# EAGLE board Resistor_Resistor (EAGLE 8.3.0), part 16 of 32
## Placement (x,y rotation side) (continued)
R19241  10K  [0201]  142.39,25.65 0 top
R19242  10K  [0201]  142.39,26.26 0 top
R19243  10K  [0201]  142.39,26.87 0 top
R19244  10K  [0201]  142.39,27.48 0 top
R19245  10K  [0201]  142.39,28.09 0 top
R19246  10K  [0201]  142.39,28.7 0 top
R19247  10K  [0201]  142.39,29.31 0 top
R19248  10K  [0201]  142.39,29.92 0 top
R19249  10K  [0201]  142.39,30.53 0 top
R19250  10K  [0201]  142.39,31.14 0 top
R19251  10K  [0201]  142.39,31.75 0 top
R19252  10K  [0201]  142.39,32.36 0 top
R19253  10K  [0201]  142.39,32.97 0 top
R19254  10K  [0201]  142.39,33.58 0 top
R19255  10K  [0201]  142.39,34.19 0 top
R19256  10K  [0201]  142.39,34.8 0 top
R19257  10K  [0201]  142.39,35.41 0 top
R19258  10K  [0201]  142.39,36.02 0 top
R19259  10K  [0201]  142.39,36.63 0 top
R19260  10K  [0201]  142.39,37.24 0 top
R19261  10K  [0201]  142.39,37.85 0 top
R19262  10K  [0201]  142.39,38.46 0 top
R19263  10K  [0201]  142.39,39.07 0 top
R19264  10K  [0201]  142.39,39.67 0 top
R19265  10K  [0201]  142.39,40.28 0 top
R19266  10K  [0201]  142.39,40.89 0 top
R19267  10K  [0201]  142.39,41.5 0 top
R19268  10K  [0201]  142.39,42.11 0 top
R19269  10K  [0201]  142.39,42.72 0 top
R19270  10K  [0201]  142.39,43.33 0 top
R19271  10K  [0201]  142.39,43.94 0 top
R19272  10K  [0201]  142.39,44.55 0 top
R19273  10K  [0201]  142.39,45.16 0 top
R19274  10K  [0201]  142.39,45.77 0 top
R19275  10K  [0201]  142.39,46.38 0 top
R19276  10K  [0201]  142.39,46.99 0 top
R19277  10K  [0201]  142.39,47.6 0 top
R19278  10K  [0201]  142.39,48.21 0 top
R19279  10K  [0201]  142.39,48.82 0 top
R19280  10K  [0201]  142.39,49.43 0 top
R19281  10K  [0201]  142.39,50.04 0 top
R19282  10K  [0201]  142.39,50.65 0 top
R19283  10K  [0201]  142.39,51.26 0 top
R19284  10K  [0201]  142.39,51.87 0 top
R19285  10K  [0201]  142.39,52.48 0 top
R19286  10K  [0201]  142.39,53.09 0 top
R19287  10K  [0201]  142.39,53.7 0 top
R19288  10K  [0201]  142.39,54.31 0 top
R19289  10K  [0201]  142.39,54.91 0 top
R19290  10K  [0201]  142.39,55.52 0 top
R19291  10K  [0201]  142.39,56.13 0 top
R19292  10K  [0201]  142.39,56.74 0 top
R19293  10K  [0201]  142.39,57.35 0 top
R19294  10K  [0201]  142.39,57.96 0 top
R19295  10K  [0201]  142.39,58.57 0 top
R19296  10K  [0201]  142.39,59.18 0 top
R19297  10K  [0201]  142.39,59.79 0 top
R19298  10K  [0201]  142.39,60.4 0 top
R19299  10K  [0201]  142.39,61.01 0 top
R19300  10K  [0201]  142.39,61.62 0 top
R19301  10K  [0201]  142.39,62.23 0 top
R19302  10K  [0201]  142.39,62.84 0 top
R19303  10K  [0201]  142.39,63.45 0 top
R19304  10K  [0201]  142.39,64.06 0 top
R19305  10K  [0201]  142.39,64.67 0 top
R19306  10K  [0201]  142.39,65.28 0 top
R19307  10K  [0201]  142.39,65.89 0 top
R19308  10K  [0201]  142.39,66.5 0 top
R19309  10K  [0201]  142.39,67.11 0 top
R19310  10K  [0201]  142.39,67.72 0 top
R19311  10K  [0201]  142.39,68.33 0 top
R19312  10K  [0201]  142.39,68.94 0 top
R19313  10K  [0201]  142.39,69.55 0 top
R19314  10K  [0201]  142.39,70.15 0 top
R19315  10K  [0201]  142.39,70.76 0 top
R19316  10K  [0201]  142.39,71.37 0 top
R19317  10K  [0201]  142.39,71.98 0 top
R19318  10K  [0201]  142.39,72.59 0 top
R19319  10K  [0201]  142.39,73.2 0 top
R19320  10K  [0201]  142.39,73.81 0 top
R19321  10K  [0201]  142.39,74.42 0 top
R19322  10K  [0201]  142.39,75.03 0 top
R19323  10K  [0201]  142.39,75.64 0 top
R19324  10K  [0201]  142.39,76.25 0 top
R19325  10K  [0201]  142.39,76.86 0 top
R19326  10K  [0201]  142.39,77.47 0 top
R19327  10K  [0201]  142.39,78.08 0 top
R19328  10K  [0201]  142.39,78.69 0 top
R19329  10K  [0201]  142.39,79.3 0 top
R19330  10K  [0201]  142.39,79.91 0 top
R19331  10K  [0201]  142.39,80.52 0 top
R19332  10K  [0201]  142.39,81.13 0 top
R19333  10K  [0201]  142.39,81.74 0 top
R19334  10K  [0201]  142.39,82.35 0 top
R19335  10K  [0201]  142.39,82.96 0 top
R19336  10K  [0201]  142.39,83.57 0 top
R19337  10K  [0201]  142.39,84.18 0 top
R19338  10K  [0201]  142.39,84.79 0 top
R19339  10K  [0201]  142.39,85.39 0 top
R19340  10K  [0201]  142.39,86 0 top
R19341  10K  [0201]  142.39,86.61 0 top
R19342  10K  [0201]  142.39,87.22 0 top
R19343  10K  [0201]  142.39,87.83 0 top
R19344  10K  [0201]  142.39,88.44 0 top
R19345  10K  [0201]  142.39,89.05 0 top
R19346  10K  [0201]  142.39,89.66 0 top
R19347  10K  [0201]  142.39,90.27 0 top
R19348  10K  [0201]  142.39,90.88 0 top
R19349  10K  [0201]  142.39,91.49 0 top
R19350  10K  [0201]  142.39,92.1 0 top
R19351  10K  [0201]  142.39,92.71 0 top
R19352  10K  [0201]  142.39,93.32 0 top
R19353  10K  [0201]  142.39,93.93 0 top
R19354  10K  [0201]  142.39,94.54 0 top
R19355  10K  [0201]  142.39,95.15 0 top
R19356  10K  [0201]  142.39,95.76 0 top
R19357  10K  [0201]  142.39,96.37 0 top
R19358  10K  [0201]  142.39,96.98 0 top
R19359  10K  [0201]  142.39,97.59 0 top
R19360  10K  [0201]  142.39,98.2 0 top
R19361  10K  [0201]  142.39,98.81 0 top
R19362  10K  [0201]  142.39,99.42 0 top
R19363  10K  [0201]  142.39,100.03 0 top
R19364  10K  [0201]  142.39,100.63 0 top
R19365  10K  [0201]  142.39,101.24 0 top
R19366  10K  [0201]  142.39,101.85 0 top
R19367  10K  [0201]  142.39,102.46 0 top
R19368  10K  [0201]  142.39,103.07 0 top
R19369  10K  [0201]  142.39,103.68 0 top
R19370  10K  [0201]  142.39,104.29 0 top
R19371  10K  [0201]  142.39,104.9 0 top
R19372  10K  [0201]  142.39,105.51 0 top
R19373  10K  [0201]  142.39,106.12 0 top
R19374  10K  [0201]  142.39,106.73 0 top
R19375  10K  [0201]  142.39,107.34 0 top
R19376  10K  [0201]  142.39,107.95 0 top
R19377  10K  [0201]  142.39,108.56 0 top
R19378  10K  [0201]  142.39,109.17 0 top
R19379  10K  [0201]  142.39,109.78 0 top
R19380  10K  [0201]  142.39,110.39 0 top
R19381  10K  [0201]  142.39,111 0 top
R19382  10K  [0201]  142.39,111.61 0 top
R19383  10K  [0201]  142.39,112.22 0 top
R19384  10K  [0201]  142.39,112.83 0 top
R19385  10K  [0201]  142.39,113.44 0 top
R19386  10K  [0201]  142.39,114.05 0 top
R19387  10K  [0201]  142.39,114.66 0 top
R19388  10K  [0201]  142.39,115.27 0 top
R19389  10K  [0201]  142.39,115.87 0 top
R19390  10K  [0201]  142.39,116.48 0 top
R19391  10K  [0201]  142.39,117.09 0 top
R19392  10K  [0201]  142.39,117.7 0 top
R19393  10K  [0201]  142.39,118.31 0 top
R19394  10K  [0201]  142.39,118.92 0 top
R19395  10K  [0201]  142.39,119.53 0 top
R19396  10K  [0201]  142.39,120.14 0 top
R19397  10K  [0201]  142.39,120.75 0 top
R19398  10K  [0201]  142.39,121.36 0 top
R19399  10K  [0201]  142.39,121.97 0 top
R19400  10K  [0201]  142.39,122.58 0 top
R19401  10K  [0201]  143.61,1.27 0 top
R19402  10K  [0201]  143.61,1.88 0 top
R19403  10K  [0201]  143.61,2.49 0 top
R19404  10K  [0201]  143.61,3.1 0 top
R19405  10K  [0201]  143.61,3.71 0 top
R19406  10K  [0201]  143.61,4.32 0 top
R19407  10K  [0201]  143.61,4.93 0 top
R19408  10K  [0201]  143.61,5.54 0 top
R19409  10K  [0201]  143.61,6.15 0 top
R19410  10K  [0201]  143.61,6.76 0 top
R19411  10K  [0201]  143.61,7.37 0 top
R19412  10K  [0201]  143.61,7.98 0 top
R19413  10K  [0201]  143.61,8.59 0 top
R19414  10K  [0201]  143.61,9.19 0 top
R19415  10K  [0201]  143.61,9.8 0 top
R19416  10K  [0201]  143.61,10.41 0 top
R19417  10K  [0201]  143.61,11.02 0 top
R19418  10K  [0201]  143.61,11.63 0 top
R19419  10K  [0201]  143.61,12.24 0 top
R19420  10K  [0201]  143.61,12.85 0 top
R19421  10K  [0201]  143.61,13.46 0 top
R19422  10K  [0201]  143.61,14.07 0 top
R19423  10K  [0201]  143.61,14.68 0 top
R19424  10K  [0201]  143.61,15.29 0 top
R19425  10K  [0201]  143.61,15.9 0 top
R19426  10K  [0201]  143.61,16.51 0 top
R19427  10K  [0201]  143.61,17.12 0 top
R19428  10K  [0201]  143.61,17.73 0 top
R19429  10K  [0201]  143.61,18.34 0 top
R19430  10K  [0201]  143.61,18.95 0 top
R19431  10K  [0201]  143.61,19.56 0 top
R19432  10K  [0201]  143.61,20.17 0 top
R19433  10K  [0201]  143.61,20.78 0 top
R19434  10K  [0201]  143.61,21.39 0 top
R19435  10K  [0201]  143.61,22 0 top
R19436  10K  [0201]  143.61,22.61 0 top
R19437  10K  [0201]  143.61,23.22 0 top
R19438  10K  [0201]  143.61,23.83 0 top
R19439  10K  [0201]  143.61,24.43 0 top
R19440  10K  [0201]  143.61,25.04 0 top
R19441  10K  [0201]  143.61,25.65 0 top
R19442  10K  [0201]  143.61,26.26 0 top
R19443  10K  [0201]  143.61,26.87 0 top
R19444  10K  [0201]  143.61,27.48 0 top
R19445  10K  [0201]  143.61,28.09 0 top
R19446  10K  [0201]  143.61,28.7 0 top
R19447  10K  [0201]  143.61,29.31 0 top
R19448  10K  [0201]  143.61,29.92 0 top
R19449  10K  [0201]  143.61,30.53 0 top
R19450  10K  [0201]  143.61,31.14 0 top
R19451  10K  [0201]  143.61,31.75 0 top
R19452  10K  [0201]  143.61,32.36 0 top
R19453  10K  [0201]  143.61,32.97 0 top
R19454  10K  [0201]  143.61,33.58 0 top
R19455  10K  [0201]  143.61,34.19 0 top
R19456  10K  [0201]  143.61,34.8 0 top
R19457  10K  [0201]  143.61,35.41 0 top
R19458  10K  [0201]  143.61,36.02 0 top
R19459  10K  [0201]  143.61,36.63 0 top
R19460  10K  [0201]  143.61,37.24 0 top
R19461  10K  [0201]  143.61,37.85 0 top
R19462  10K  [0201]  143.61,38.46 0 top
R19463  10K  [0201]  143.61,39.07 0 top
R19464  10K  [0201]  143.61,39.67 0 top
R19465  10K  [0201]  143.61,40.28 0 top
R19466  10K  [0201]  143.61,40.89 0 top
R19467  10K  [0201]  143.61,41.5 0 top
R19468  10K  [0201]  143.61,42.11 0 top
R19469  10K  [0201]  143.61,42.72 0 top
R19470  10K  [0201]  143.61,43.33 0 top
R19471  10K  [0201]  143.61,43.94 0 top
R19472  10K  [0201]  143.61,44.55 0 top
R19473  10K  [0201]  143.61,45.16 0 top
R19474  10K  [0201]  143.61,45.77 0 top
R19475  10K  [0201]  143.61,46.38 0 top
R19476  10K  [0201]  143.61,46.99 0 top
R19477  10K  [0201]  143.61,47.6 0 top
R19478  10K  [0201]  143.61,48.21 0 top
R19479  10K  [0201]  143.61,48.82 0 top
R19480  10K  [0201]  143.61,49.43 0 top
R19481  10K  [0201]  143.61,50.04 0 top
R19482  10K  [0201]  143.61,50.65 0 top
R19483  10K  [0201]  143.61,51.26 0 top
R19484  10K  [0201]  143.61,51.87 0 top
R19485  10K  [0201]  143.61,52.48 0 top
R19486  10K  [0201]  143.61,53.09 0 top
R19487  10K  [0201]  143.61,53.7 0 top
R19488  10K  [0201]  143.61,54.31 0 top
R19489  10K  [0201]  143.61,54.91 0 top
R19490  10K  [0201]  143.61,55.52 0 top
R19491  10K  [0201]  143.61,56.13 0 top
R19492  10K  [0201]  143.61,56.74 0 top
R19493  10K  [0201]  143.61,57.35 0 top
R19494  10K  [0201]  143.61,57.96 0 top
R19495  10K  [0201]  143.61,58.57 0 top
R19496  10K  [0201]  143.61,59.18 0 top
R19497  10K  [0201]  143.61,59.79 0 top
R19498  10K  [0201]  143.61,60.4 0 top
R19499  10K  [0201]  143.61,61.01 0 top
R19500  10K  [0201]  143.61,61.62 0 top
R19501  10K  [0201]  143.61,62.23 0 top
R19502  10K  [0201]  143.61,62.84 0 top
R19503  10K  [0201]  143.61,63.45 0 top
R19504  10K  [0201]  143.61,64.06 0 top
R19505  10K  [0201]  143.61,64.67 0 top
R19506  10K  [0201]  143.61,65.28 0 top
R19507  10K  [0201]  143.61,65.89 0 top
R19508  10K  [0201]  143.61,66.5 0 top
R19509  10K  [0201]  143.61,67.11 0 top
R19510  10K  [0201]  143.61,67.72 0 top
R19511  10K  [0201]  143.61,68.33 0 top
R19512  10K  [0201]  143.61,68.94 0 top
R19513  10K  [0201]  143.61,69.55 0 top
R19514  10K  [0201]  143.61,70.15 0 top
R19515  10K  [0201]  143.61,70.76 0 top
R19516  10K  [0201]  143.61,71.37 0 top
R19517  10K  [0201]  143.61,71.98 0 top
R19518  10K  [0201]  143.61,72.59 0 top
R19519  10K  [0201]  143.61,73.2 0 top
R19520  10K  [0201]  143.61,73.81 0 top
R19521  10K  [0201]  143.61,74.42 0 top
R19522  10K  [0201]  143.61,75.03 0 top
R19523  10K  [0201]  143.61,75.64 0 top
R19524  10K  [0201]  143.61,76.25 0 top
R19525  10K  [0201]  143.61,76.86 0 top
R19526  10K  [0201]  143.61,77.47 0 top
R19527  10K  [0201]  143.61,78.08 0 top
R19528  10K  [0201]  143.61,78.69 0 top
R19529  10K  [0201]  143.61,79.3 0 top
R19530  10K  [0201]  143.61,79.91 0 top
R19531  10K  [0201]  143.61,80.52 0 top
R19532  10K  [0201]  143.61,81.13 0 top
R19533  10K  [0201]  143.61,81.74 0 top
R19534  10K  [0201]  143.61,82.35 0 top
R19535  10K  [0201]  143.61,82.96 0 top
R19536  10K  [0201]  143.61,83.57 0 top
R19537  10K  [0201]  143.61,84.18 0 top
R19538  10K  [0201]  143.61,84.79 0 top
R19539  10K  [0201]  143.61,85.39 0 top
R19540  10K  [0201]  143.61,86 0 top
R19541  10K  [0201]  143.61,86.61 0 top
R19542  10K  [0201]  143.61,87.22 0 top
R19543  10K  [0201]  143.61,87.83 0 top
R19544  10K  [0201]  143.61,88.44 0 top
R19545  10K  [0201]  143.61,89.05 0 top
R19546  10K  [0201]  143.61,89.66 0 top
R19547  10K  [0201]  143.61,90.27 0 top
R19548  10K  [0201]  143.61,90.88 0 top
R19549  10K  [0201]  143.61,91.49 0 top
R19550  10K  [0201]  143.61,92.1 0 top
R19551  10K  [0201]  143.61,92.71 0 top
R19552  10K  [0201]  143.61,93.32 0 top
R19553  10K  [0201]  143.61,93.93 0 top
R19554  10K  [0201]  143.61,94.54 0 top
R19555  10K  [0201]  143.61,95.15 0 top
R19556  10K  [0201]  143.61,95.76 0 top
R19557  10K  [0201]  143.61,96.37 0 top
R19558  10K  [0201]  143.61,96.98 0 top
R19559  10K  [0201]  143.61,97.59 0 top
R19560  10K  [0201]  143.61,98.2 0 top
R19561  10K  [0201]  143.61,98.81 0 top
R19562  10K  [0201]  143.61,99.42 0 top
R19563  10K  [0201]  143.61,100.03 0 top
R19564  10K  [0201]  143.61,100.63 0 top
R19565  10K  [0201]  143.61,101.24 0 top
R19566  10K  [0201]  143.61,101.85 0 top
R19567  10K  [0201]  143.61,102.46 0 top
R19568  10K  [0201]  143.61,103.07 0 top
R19569  10K  [0201]  143.61,103.68 0 top
R19570  10K  [0201]  143.61,104.29 0 top
R19571  10K  [0201]  143.61,104.9 0 top
R19572  10K  [0201]  143.61,105.51 0 top
R19573  10K  [0201]  143.61,106.12 0 top
R19574  10K  [0201]  143.61,106.73 0 top
R19575  10K  [0201]  143.61,107.34 0 top
R19576  10K  [0201]  143.61,107.95 0 top
R19577  10K  [0201]  143.61,108.56 0 top
R19578  10K  [0201]  143.61,109.17 0 top
R19579  10K  [0201]  143.61,109.78 0 top
R19580  10K  [0201]  143.61,110.39 0 top
R19581  10K  [0201]  143.61,111 0 top
R19582  10K  [0201]  143.61,111.61 0 top
R19583  10K  [0201]  143.61,112.22 0 top
R19584  10K  [0201]  143.61,112.83 0 top
R19585  10K  [0201]  143.61,113.44 0 top
R19586  10K  [0201]  143.61,114.05 0 top
R19587  10K  [0201]  143.61,114.66 0 top
R19588  10K  [0201]  143.61,115.27 0 top
R19589  10K  [0201]  143.61,115.87 0 top
R19590  10K  [0201]  143.61,116.48 0 top
R19591  10K  [0201]  143.61,117.09 0 top
R19592  10K  [0201]  143.61,117.7 0 top
R19593  10K  [0201]  143.61,118.31 0 top
R19594  10K  [0201]  143.61,118.92 0 top
R19595  10K  [0201]  143.61,119.53 0 top
R19596  10K  [0201]  143.61,120.14 0 top
R19597  10K  [0201]  143.61,120.75 0 top
R19598  10K  [0201]  143.61,121.36 0 top
R19599  10K  [0201]  143.61,121.97 0 top
R19600  10K  [0201]  143.61,122.58 0 top
R19601  10K  [0201]  144.83,1.27 0 top
R19602  10K  [0201]  144.83,1.88 0 top
R19603  10K  [0201]  144.83,2.49 0 top
R19604  10K  [0201]  144.83,3.1 0 top
R19605  10K  [0201]  144.83,3.71 0 top
R19606  10K  [0201]  144.83,4.32 0 top
R19607  10K  [0201]  144.83,4.93 0 top
R19608  10K  [0201]  144.83,5.54 0 top
R19609  10K  [0201]  144.83,6.15 0 top
R19610  10K  [0201]  144.83,6.76 0 top
R19611  10K  [0201]  144.83,7.37 0 top
R19612  10K  [0201]  144.83,7.98 0 top
R19613  10K  [0201]  144.83,8.59 0 top
R19614  10K  [0201]  144.83,9.19 0 top
R19615  10K  [0201]  144.83,9.8 0 top
R19616  10K  [0201]  144.83,10.41 0 top
R19617  10K  [0201]  144.83,11.02 0 top
R19618  10K  [0201]  144.83,11.63 0 top
R19619  10K  [0201]  144.83,12.24 0 top
R19620  10K  [0201]  144.83,12.85 0 top
R19621  10K  [0201]  144.83,13.46 0 top
R19622  10K  [0201]  144.83,14.07 0 top
R19623  10K  [0201]  144.83,14.68 0 top
R19624  10K  [0201]  144.83,15.29 0 top
R19625  10K  [0201]  144.83,15.9 0 top
R19626  10K  [0201]  144.83,16.51 0 top
R19627  10K  [0201]  144.83,17.12 0 top
R19628  10K  [0201]  144.83,17.73 0 top
R19629  10K  [0201]  144.83,18.34 0 top
R19630  10K  [0201]  144.83,18.95 0 top
R19631  10K  [0201]  144.83,19.56 0 top
R19632  10K  [0201]  144.83,20.17 0 top
R19633  10K  [0201]  144.83,20.78 0 top
R19634  10K  [0201]  144.83,21.39 0 top
R19635  10K  [0201]  144.83,22 0 top
R19636  10K  [0201]  144.83,22.61 0 top
R19637  10K  [0201]  144.83,23.22 0 top
R19638  10K  [0201]  144.83,23.83 0 top
R19639  10K  [0201]  144.83,24.43 0 top
R19640  10K  [0201]  144.83,25.04 0 top
R19641  10K  [0201]  144.83,25.65 0 top
R19642  10K  [0201]  144.83,26.26 0 top
R19643  10K  [0201]  144.83,26.87 0 top
R19644  10K  [0201]  144.83,27.48 0 top
R19645  10K  [0201]  144.83,28.09 0 top
R19646  10K  [0201]  144.83,28.7 0 top
R19647  10K  [0201]  144.83,29.31 0 top
R19648  10K  [0201]  144.83,29.92 0 top
R19649  10K  [0201]  144.83,30.53 0 top
R19650  10K  [0201]  144.83,31.14 0 top
R19651  10K  [0201]  144.83,31.75 0 top
R19652  10K  [0201]  144.83,32.36 0 top
R19653  10K  [0201]  144.83,32.97 0 top
R19654  10K  [0201]  144.83,33.58 0 top
R19655  10K  [0201]  144.83,34.19 0 top
R19656  10K  [0201]  144.83,34.8 0 top
R19657  10K  [0201]  144.83,35.41 0 top
R19658  10K  [0201]  144.83,36.02 0 top
R19659  10K  [0201]  144.83,36.63 0 top
R19660  10K  [0201]  144.83,37.24 0 top
R19661  10K  [0201]  144.83,37.85 0 top
R19662  10K  [0201]  144.83,38.46 0 top
R19663  10K  [0201]  144.83,39.07 0 top
R19664  10K  [0201]  144.83,39.67 0 top
R19665  10K  [0201]  144.83,40.28 0 top
R19666  10K  [0201]  144.83,40.89 0 top
R19667  10K  [0201]  144.83,41.5 0 top
R19668  10K  [0201]  144.83,42.11 0 top
R19669  10K  [0201]  144.83,42.72 0 top
R19670  10K  [0201]  144.83,43.33 0 top
R19671  10K  [0201]  144.83,43.94 0 top
R19672  10K  [0201]  144.83,44.55 0 top
R19673  10K  [0201]  144.83,45.16 0 top
R19674  10K  [0201]  144.83,45.77 0 top
R19675  10K  [0201]  144.83,46.38 0 top
R19676  10K  [0201]  144.83,46.99 0 top
R19677  10K  [0201]  144.83,47.6 0 top
R19678  10K  [0201]  144.83,48.21 0 top
R19679  10K  [0201]  144.83,48.82 0 top
R19680  10K  [0201]  144.83,49.43 0 top
R19681  10K  [0201]  144.83,50.04 0 top
R19682  10K  [0201]  144.83,50.65 0 top
R19683  10K  [0201]  144.83,51.26 0 top
R19684  10K  [0201]  144.83,51.87 0 top
R19685  10K  [0201]  144.83,52.48 0 top
R19686  10K  [0201]  144.83,53.09 0 top
R19687  10K  [0201]  144.83,53.7 0 top
R19688  10K  [0201]  144.83,54.31 0 top
R19689  10K  [0201]  144.83,54.91 0 top
R19690  10K  [0201]  144.83,55.52 0 top
R19691  10K  [0201]  144.83,56.13 0 top
R19692  10K  [0201]  144.83,56.74 0 top
R19693  10K  [0201]  144.83,57.35 0 top
R19694  10K  [0201]  144.83,57.96 0 top
R19695  10K  [0201]  144.83,58.57 0 top
R19696  10K  [0201]  144.83,59.18 0 top
R19697  10K  [0201]  144.83,59.79 0 top
R19698  10K  [0201]  144.83,60.4 0 top
R19699  10K  [0201]  144.83,61.01 0 top
R19700  10K  [0201]  144.83,61.62 0 top
R19701  10K  [0201]  144.83,62.23 0 top
R19702  10K  [0201]  144.83,62.84 0 top
R19703  10K  [0201]  144.83,63.45 0 top
R19704  10K  [0201]  144.83,64.06 0 top
R19705  10K  [0201]  144.83,64.67 0 top
R19706  10K  [0201]  144.83,65.28 0 top
R19707  10K  [0201]  144.83,65.89 0 top
R19708  10K  [0201]  144.83,66.5 0 top
R19709  10K  [0201]  144.83,67.11 0 top
R19710  10K  [0201]  144.83,67.72 0 top
R19711  10K  [0201]  144.83,68.33 0 top
R19712  10K  [0201]  144.83,68.94 0 top
R19713  10K  [0201]  144.83,69.55 0 top
R19714  10K  [0201]  144.83,70.15 0 top
R19715  10K  [0201]  144.83,70.76 0 top
R19716  10K  [0201]  144.83,71.37 0 top
R19717  10K  [0201]  144.83,71.98 0 top
R19718  10K  [0201]  144.83,72.59 0 top
R19719  10K  [0201]  144.83,73.2 0 top
R19720  10K  [0201]  144.83,73.81 0 top
R19721  10K  [0201]  144.83,74.42 0 top
R19722  10K  [0201]  144.83,75.03 0 top
R19723  10K  [0201]  144.83,75.64 0 top
R19724  10K  [0201]  144.83,76.25 0 top
R19725  10K  [0201]  144.83,76.86 0 top
R19726  10K  [0201]  144.83,77.47 0 top
R19727  10K  [0201]  144.83,78.08 0 top
R19728  10K  [0201]  144.83,78.69 0 top
R19729  10K  [0201]  144.83,79.3 0 top
R19730  10K  [0201]  144.83,79.91 0 top
R19731  10K  [0201]  144.83,80.52 0 top
R19732  10K  [0201]  144.83,81.13 0 top
R19733  10K  [0201]  144.83,81.74 0 top
R19734  10K  [0201]  144.83,82.35 0 top
R19735  10K  [0201]  144.83,82.96 0 top
R19736  10K  [0201]  144.83,83.57 0 top
R19737  10K  [0201]  144.83,84.18 0 top
R19738  10K  [0201]  144.83,84.79 0 top
R19739  10K  [0201]  144.83,85.39 0 top
R19740  10K  [0201]  144.83,86 0 top
R19741  10K  [0201]  144.83,86.61 0 top
R19742  10K  [0201]  144.83,87.22 0 top
R19743  10K  [0201]  144.83,87.83 0 top
R19744  10K  [0201]  144.83,88.44 0 top
R19745  10K  [0201]  144.83,89.05 0 top
R19746  10K  [0201]  144.83,89.66 0 top
R19747  10K  [0201]  144.83,90.27 0 top
R19748  10K  [0201]  144.83,90.88 0 top
R19749  10K  [0201]  144.83,91.49 0 top
R19750  10K  [0201]  144.83,92.1 0 top
R19751  10K  [0201]  144.83,92.71 0 top
R19752  10K  [0201]  144.83,93.32 0 top
R19753  10K  [0201]  144.83,93.93 0 top
R19754  10K  [0201]  144.83,94.54 0 top
R19755  10K  [0201]  144.83,95.15 0 top
R19756  10K  [0201]  144.83,95.76 0 top
R19757  10K  [0201]  144.83,96.37 0 top
R19758  10K  [0201]  144.83,96.98 0 top
R19759  10K  [0201]  144.83,97.59 0 top
R19760  10K  [0201]  144.83,98.2 0 top
R19761  10K  [0201]  144.83,98.81 0 top
R19762  10K  [0201]  144.83,99.42 0 top
R19763  10K  [0201]  144.83,100.03 0 top
R19764  10K  [0201]  144.83,100.63 0 top
R19765  10K  [0201]  144.83,101.24 0 top
R19766  10K  [0201]  144.83,101.85 0 top
R19767  10K  [0201]  144.83,102.46 0 top
R19768  10K  [0201]  144.83,103.07 0 top
R19769  10K  [0201]  144.83,103.68 0 top
R19770  10K  [0201]  144.83,104.29 0 top
R19771  10K  [0201]  144.83,104.9 0 top
R19772  10K  [0201]  144.83,105.51 0 top
R19773  10K  [0201]  144.83,106.12 0 top
R19774  10K  [0201]  144.83,106.73 0 top
R19775  10K  [0201]  144.83,107.34 0 top
R19776  10K  [0201]  144.83,107.95 0 top
R19777  10K  [0201]  144.83,108.56 0 top
R19778  10K  [0201]  144.83,109.17 0 top
R19779  10K  [0201]  144.83,109.78 0 top
R19780  10K  [0201]  144.83,110.39 0 top
R19781  10K  [0201]  144.83,111 0 top
R19782  10K  [0201]  144.83,111.61 0 top
R19783  10K  [0201]  144.83,112.22 0 top
R19784  10K  [0201]  144.83,112.83 0 top
R19785  10K  [0201]  144.83,113.44 0 top
R19786  10K  [0201]  144.83,114.05 0 top
R19787  10K  [0201]  144.83,114.66 0 top
R19788  10K  [0201]  144.83,115.27 0 top
R19789  10K  [0201]  144.83,115.87 0 top
R19790  10K  [0201]  144.83,116.48 0 top
R19791  10K  [0201]  144.83,117.09 0 top
R19792  10K  [0201]  144.83,117.7 0 top
R19793  10K  [0201]  144.83,118.31 0 top
R19794  10K  [0201]  144.83,118.92 0 top
R19795  10K  [0201]  144.83,119.53 0 top
R19796  10K  [0201]  144.83,120.14 0 top
R19797  10K  [0201]  144.83,120.75 0 top
R19798  10K  [0201]  144.83,121.36 0 top
R19799  10K  [0201]  144.83,121.97 0 top
R19800  10K  [0201]  144.83,122.58 0 top
R19801  10K  [0201]  146.05,1.27 0 top
R19802  10K  [0201]  146.05,1.88 0 top
R19803  10K  [0201]  146.05,2.49 0 top
R19804  10K  [0201]  146.05,3.1 0 top
R19805  10K  [0201]  146.05,3.71 0 top
R19806  10K  [0201]  146.05,4.32 0 top
R19807  10K  [0201]  146.05,4.93 0 top
R19808  10K  [0201]  146.05,5.54 0 top
R19809  10K  [0201]  146.05,6.15 0 top
R19810  10K  [0201]  146.05,6.76 0 top
R19811  10K  [0201]  146.05,7.37 0 top
R19812  10K  [0201]  146.05,7.98 0 top
R19813  10K  [0201]  146.05,8.59 0 top
R19814  10K  [0201]  146.05,9.19 0 top
R19815  10K  [0201]  146.05,9.8 0 top
R19816  10K  [0201]  146.05,10.41 0 top
R19817  10K  [0201]  146.05,11.02 0 top
R19818  10K  [0201]  146.05,11.63 0 top
R19819  10K  [0201]  146.05,12.24 0 top
R19820  10K  [0201]  146.05,12.85 0 top
R19821  10K  [0201]  146.05,13.46 0 top
R19822  10K  [0201]  146.05,14.07 0 top
R19823  10K  [0201]  146.05,14.68 0 top
R19824  10K  [0201]  146.05,15.29 0 top
R19825  10K  [0201]  146.05,15.9 0 top
R19826  10K  [0201]  146.05,16.51 0 top
R19827  10K  [0201]  146.05,17.12 0 top
R19828  10K  [0201]  146.05,17.73 0 top
R19829  10K  [0201]  146.05,18.34 0 top
R19830  10K  [0201]  146.05,18.95 0 top
R19831  10K  [0201]  146.05,19.56 0 top
R19832  10K  [0201]  146.05,20.17 0 top
R19833  10K  [0201]  146.05,20.78 0 top
R19834  10K  [0201]  146.05,21.39 0 top
R19835  10K  [0201]  146.05,22 0 top
R19836  10K  [0201]  146.05,22.61 0 top
R19837  10K  [0201]  146.05,23.22 0 top
R19838  10K  [0201]  146.05,23.83 0 top
R19839  10K  [0201]  146.05,24.43 0 top
R19840  10K  [0201]  146.05,25.04 0 top
R19841  10K  [0201]  146.05,25.65 0 top
R19842  10K  [0201]  146.05,26.26 0 top
R19843  10K  [0201]  146.05,26.87 0 top
R19844  10K  [0201]  146.05,27.48 0 top
R19845  10K  [0201]  146.05,28.09 0 top
R19846  10K  [0201]  146.05,28.7 0 top
R19847  10K  [0201]  146.05,29.31 0 top
R19848  10K  [0201]  146.05,29.92 0 top
R19849  10K  [0201]  146.05,30.53 0 top
R19850  10K  [0201]  146.05,31.14 0 top
R19851  10K  [0201]  146.05,31.75 0 top
R19852  10K  [0201]  146.05,32.36 0 top
R19853  10K  [0201]  146.05,32.97 0 top
R19854  10K  [0201]  146.05,33.58 0 top
R19855  10K  [0201]  146.05,34.19 0 top
R19856  10K  [0201]  146.05,34.8 0 top
R19857  10K  [0201]  146.05,35.41 0 top
R19858  10K  [0201]  146.05,36.02 0 top
R19859  10K  [0201]  146.05,36.63 0 top
R19860  10K  [0201]  146.05,37.24 0 top
R19861  10K  [0201]  146.05,37.85 0 top
R19862  10K  [0201]  146.05,38.46 0 top
R19863  10K  [0201]  146.05,39.07 0 top
R19864  10K  [0201]  146.05,39.67 0 top
R19865  10K  [0201]  146.05,40.28 0 top
R19866  10K  [0201]  146.05,40.89 0 top
R19867  10K  [0201]  146.05,41.5 0 top
R19868  10K  [0201]  146.05,42.11 0 top
R19869  10K  [0201]  146.05,42.72 0 top
R19870  10K  [0201]  146.05,43.33 0 top
R19871  10K  [0201]  146.05,43.94 0 top
R19872  10K  [0201]  146.05,44.55 0 top
R19873  10K  [0201]  146.05,45.16 0 top
R19874  10K  [0201]  146.05,45.77 0 top
R19875  10K  [0201]  146.05,46.38 0 top
R19876  10K  [0201]  146.05,46.99 0 top
R19877  10K  [0201]  146.05,47.6 0 top
R19878  10K  [0201]  146.05,48.21 0 top
R19879  10K  [0201]  146.05,48.82 0 top
R19880  10K  [0201]  146.05,49.43 0 top
R19881  10K  [0201]  146.05,50.04 0 top
R19882  10K  [0201]  146.05,50.65 0 top
R19883  10K  [0201]  146.05,51.26 0 top
R19884  10K  [0201]  146.05,51.87 0 top
R19885  10K  [0201]  146.05,52.48 0 top
R19886  10K  [0201]  146.05,53.09 0 top
R19887  10K  [0201]  146.05,53.7 0 top
R19888  10K  [0201]  146.05,54.31 0 top
R19889  10K  [0201]  146.05,54.91 0 top
R19890  10K  [0201]  146.05,55.52 0 top
R19891  10K  [0201]  146.05,56.13 0 top
R19892  10K  [0201]  146.05,56.74 0 top
R19893  10K  [0201]  146.05,57.35 0 top
R19894  10K  [0201]  146.05,57.96 0 top
R19895  10K  [0201]  146.05,58.57 0 top
R19896  10K  [0201]  146.05,59.18 0 top
R19897  10K  [0201]  146.05,59.79 0 top
R19898  10K  [0201]  146.05,60.4 0 top
R19899  10K  [0201]  146.05,61.01 0 top
R19900  10K  [0201]  146.05,61.62 0 top
R19901  10K  [0201]  146.05,62.23 0 top
R19902  10K  [0201]  146.05,62.84 0 top
R19903  10K  [0201]  146.05,63.45 0 top
R19904  10K  [0201]  146.05,64.06 0 top
R19905  10K  [0201]  146.05,64.67 0 top
R19906  10K  [0201]  146.05,65.28 0 top
R19907  10K  [0201]  146.05,65.89 0 top
R19908  10K  [0201]  146.05,66.5 0 top
R19909  10K  [0201]  146.05,67.11 0 top
R19910  10K  [0201]  146.05,67.72 0 top
R19911  10K  [0201]  146.05,68.33 0 top
R19912  10K  [0201]  146.05,68.94 0 top
R19913  10K  [0201]  146.05,69.55 0 top
R19914  10K  [0201]  146.05,70.15 0 top
R19915  10K  [0201]  146.05,70.76 0 top
R19916  10K  [0201]  146.05,71.37 0 top
R19917  10K  [0201]  146.05,71.98 0 top
R19918  10K  [0201]  146.05,72.59 0 top
R19919  10K  [0201]  146.05,73.2 0 top
R19920  10K  [0201]  146.05,73.81 0 top
R19921  10K  [0201]  146.05,74.42 0 top
R19922  10K  [0201]  146.05,75.03 0 top
R19923  10K  [0201]  146.05,75.64 0 top
R19924  10K  [0201]  146.05,76.25 0 top
R19925  10K  [0201]  146.05,76.86 0 top
R19926  10K  [0201]  146.05,77.47 0 top
R19927  10K  [0201]  146.05,78.08 0 top
R19928  10K  [0201]  146.05,78.69 0 top
R19929  10K  [0201]  146.05,79.3 0 top
R19930  10K  [0201]  146.05,79.91 0 top
R19931  10K  [0201]  146.05,80.52 0 top
R19932  10K  [0201]  146.05,81.13 0 top
R19933  10K  [0201]  146.05,81.74 0 top
R19934  10K  [0201]  146.05,82.35 0 top
R19935  10K  [0201]  146.05,82.96 0 top
R19936  10K  [0201]  146.05,83.57 0 top
R19937  10K  [0201]  146.05,84.18 0 top
R19938  10K  [0201]  146.05,84.79 0 top
R19939  10K  [0201]  146.05,85.39 0 top
R19940  10K  [0201]  146.05,86 0 top
R19941  10K  [0201]  146.05,86.61 0 top
R19942  10K  [0201]  146.05,87.22 0 top
R19943  10K  [0201]  146.05,87.83 0 top
R19944  10K  [0201]  146.05,88.44 0 top
R19945  10K  [0201]  146.05,89.05 0 top
R19946  10K  [0201]  146.05,89.66 0 top
R19947  10K  [0201]  146.05,90.27 0 top
R19948  10K  [0201]  146.05,90.88 0 top
R19949  10K  [0201]  146.05,91.49 0 top
R19950  10K  [0201]  146.05,92.1 0 top
R19951  10K  [0201]  146.05,92.71 0 top
R19952  10K  [0201]  146.05,93.32 0 top
R19953  10K  [0201]  146.05,93.93 0 top
R19954  10K  [0201]  146.05,94.54 0 top
R19955  10K  [0201]  146.05,95.15 0 top
R19956  10K  [0201]  146.05,95.76 0 top
R19957  10K  [0201]  146.05,96.37 0 top
R19958  10K  [0201]  146.05,96.98 0 top
R19959  10K  [0201]  146.05,97.59 0 top
R19960  10K  [0201]  146.05,98.2 0 top
R19961  10K  [0201]  146.05,98.81 0 top
R19962  10K  [0201]  146.05,99.42 0 top
R19963  10K  [0201]  146.05,100.03 0 top
R19964  10K  [0201]  146.05,100.63 0 top
R19965  10K  [0201]  146.05,101.24 0 top
R19966  10K  [0201]  146.05,101.85 0 top
R19967  10K  [0201]  146.05,102.46 0 top
R19968  10K  [0201]  146.05,103.07 0 top
R19969  10K  [0201]  146.05,103.68 0 top
R19970  10K  [0201]  146.05,104.29 0 top
R19971  10K  [0201]  146.05,104.9 0 top
R19972  10K  [0201]  146.05,105.51 0 top
R19973  10K  [0201]  146.05,106.12 0 top
R19974  10K  [0201]  146.05,106.73 0 top
R19975  10K  [0201]  146.05,107.34 0 top
R19976  10K  [0201]  146.05,107.95 0 top
R19977  10K  [0201]  146.05,108.56 0 top
R19978  10K  [0201]  146.05,109.17 0 top
R19979  10K  [0201]  146.05,109.78 0 top
R19980  10K  [0201]  146.05,110.39 0 top
R19981  10K  [0201]  146.05,111 0 top
R19982  10K  [0201]  146.05,111.61 0 top
R19983  10K  [0201]  146.05,112.22 0 top
R19984  10K  [0201]  146.05,112.83 0 top
R19985  10K  [0201]  146.05,113.44 0 top
R19986  10K  [0201]  146.05,114.05 0 top
R19987  10K  [0201]  146.05,114.66 0 top
R19988  10K  [0201]  146.05,115.27 0 top
R19989  10K  [0201]  146.05,115.87 0 top
R19990  10K  [0201]  146.05,116.48 0 top
R19991  10K  [0201]  146.05,117.09 0 top
R19992  10K  [0201]  146.05,117.7 0 top
R19993  10K  [0201]  146.05,118.31 0 top
R19994  10K  [0201]  146.05,118.92 0 top
R19995  10K  [0201]  146.05,119.53 0 top
R19996  10K  [0201]  146.05,120.14 0 top
R19997  10K  [0201]  146.05,120.75 0 top
R19998  10K  [0201]  146.05,121.36 0 top
R19999  10K  [0201]  146.05,121.97 0 top
R20000  10K  [0201]  146.05,122.58 0 top
R20001  10K  [0201]  147.27,1.27 0 top
R20002  10K  [0201]  147.27,1.88 0 top
R20003  10K  [0201]  147.27,2.49 0 top
R20004  10K  [0201]  147.27,3.1 0 top
R20005  10K  [0201]  147.27,3.71 0 top
R20006  10K  [0201]  147.27,4.32 0 top
R20007  10K  [0201]  147.27,4.93 0 top
R20008  10K  [0201]  147.27,5.54 0 top
R20009  10K  [0201]  147.27,6.15 0 top
R20010  10K  [0201]  147.27,6.76 0 top
R20011  10K  [0201]  147.27,7.37 0 top
R20012  10K  [0201]  147.27,7.98 0 top
R20013  10K  [0201]  147.27,8.59 0 top
R20014  10K  [0201]  147.27,9.19 0 top
R20015  10K  [0201]  147.27,9.8 0 top
R20016  10K  [0201]  147.27,10.41 0 top
R20017  10K  [0201]  147.27,11.02 0 top
R20018  10K  [0201]  147.27,11.63 0 top
R20019  10K  [0201]  147.27,12.24 0 top
R20020  10K  [0201]  147.27,12.85 0 top
R20021  10K  [0201]  147.27,13.46 0 top
R20022  10K  [0201]  147.27,14.07 0 top
R20023  10K  [0201]  147.27,14.68 0 top
R20024  10K  [0201]  147.27,15.29 0 top
R20025  10K  [0201]  147.27,15.9 0 top
R20026  10K  [0201]  147.27,16.51 0 top
R20027  10K  [0201]  147.27,17.12 0 top
R20028  10K  [0201]  147.27,17.73 0 top
R20029  10K  [0201]  147.27,18.34 0 top
R20030  10K  [0201]  147.27,18.95 0 top
R20031  10K  [0201]  147.27,19.56 0 top
R20032  10K  [0201]  147.27,20.17 0 top
R20033  10K  [0201]  147.27,20.78 0 top
R20034  10K  [0201]  147.27,21.39 0 top
R20035  10K  [0201]  147.27,22 0 top
R20036  10K  [0201]  147.27,22.61 0 top
R20037  10K  [0201]  147.27,23.22 0 top
R20038  10K  [0201]  147.27,23.83 0 top
R20039  10K  [0201]  147.27,24.43 0 top
R20040  10K  [0201]  147.27,25.04 0 top
R20041  10K  [0201]  147.27,25.65 0 top
R20042  10K  [0201]  147.27,26.26 0 top
R20043  10K  [0201]  147.27,26.87 0 top
R20044  10K  [0201]  147.27,27.48 0 top
R20045  10K  [0201]  147.27,28.09 0 top
R20046  10K  [0201]  147.27,28.7 0 top
R20047  10K  [0201]  147.27,29.31 0 top
R20048  10K  [0201]  147.27,29.92 0 top
R20049  10K  [0201]  147.27,30.53 0 top
R20050  10K  [0201]  147.27,31.14 0 top
R20051  10K  [0201]  147.27,31.75 0 top
R20052  10K  [0201]  147.27,32.36 0 top
R20053  10K  [0201]  147.27,32.97 0 top
R20054  10K  [0201]  147.27,33.58 0 top
R20055  10K  [0201]  147.27,34.19 0 top
R20056  10K  [0201]  147.27,34.8 0 top
R20057  10K  [0201]  147.27,35.41 0 top
R20058  10K  [0201]  147.27,36.02 0 top
R20059  10K  [0201]  147.27,36.63 0 top
R20060  10K  [0201]  147.27,37.24 0 top
R20061  10K  [0201]  147.27,37.85 0 top
R20062  10K  [0201]  147.27,38.46 0 top
R20063  10K  [0201]  147.27,39.07 0 top
R20064  10K  [0201]  147.27,39.67 0 top
R20065  10K  [0201]  147.27,40.28 0 top
R20066  10K  [0201]  147.27,40.89 0 top
R20067  10K  [0201]  147.27,41.5 0 top
R20068  10K  [0201]  147.27,42.11 0 top
R20069  10K  [0201]  147.27,42.72 0 top
R20070  10K  [0201]  147.27,43.33 0 top
R20071  10K  [0201]  147.27,43.94 0 top
R20072  10K  [0201]  147.27,44.55 0 top
R20073  10K  [0201]  147.27,45.16 0 top
R20074  10K  [0201]  147.27,45.77 0 top
R20075  10K  [0201]  147.27,46.38 0 top
R20076  10K  [0201]  147.27,46.99 0 top
R20077  10K  [0201]  147.27,47.6 0 top
R20078  10K  [0201]  147.27,48.21 0 top
R20079  10K  [0201]  147.27,48.82 0 top
R20080  10K  [0201]  147.27,49.43 0 top
R20081  10K  [0201]  147.27,50.04 0 top
R20082  10K  [0201]  147.27,50.65 0 top
R20083  10K  [0201]  147.27,51.26 0 top
R20084  10K  [0201]  147.27,51.87 0 top
R20085  10K  [0201]  147.27,52.48 0 top
R20086  10K  [0201]  147.27,53.09 0 top
R20087  10K  [0201]  147.27,53.7 0 top
R20088  10K  [0201]  147.27,54.31 0 top
R20089  10K  [0201]  147.27,54.91 0 top
R20090  10K  [0201]  147.27,55.52 0 top
R20091  10K  [0201]  147.27,56.13 0 top
R20092  10K  [0201]  147.27,56.74 0 top
R20093  10K  [0201]  147.27,57.35 0 top
R20094  10K  [0201]  147.27,57.96 0 top
R20095  10K  [0201]  147.27,58.57 0 top
R20096  10K  [0201]  147.27,59.18 0 top
R20097  10K  [0201]  147.27,59.79 0 top
R20098  10K  [0201]  147.27,60.4 0 top
R20099  10K  [0201]  147.27,61.01 0 top
R20100  10K  [0201]  147.27,61.62 0 top
R20101  10K  [0201]  147.27,62.23 0 top
R20102  10K  [0201]  147.27,62.84 0 top
R20103  10K  [0201]  147.27,63.45 0 top
R20104  10K  [0201]  147.27,64.06 0 top
R20105  10K  [0201]  147.27,64.67 0 top
R20106  10K  [0201]  147.27,65.28 0 top
R20107  10K  [0201]  147.27,65.89 0 top
R20108  10K  [0201]  147.27,66.5 0 top
R20109  10K  [0201]  147.27,67.11 0 top
R20110  10K  [0201]  147.27,67.72 0 top
R20111  10K  [0201]  147.27,68.33 0 top
R20112  10K  [0201]  147.27,68.94 0 top
R20113  10K  [0201]  147.27,69.55 0 top
R20114  10K  [0201]  147.27,70.15 0 top
R20115  10K  [0201]  147.27,70.76 0 top
R20116  10K  [0201]  147.27,71.37 0 top
R20117  10K  [0201]  147.27,71.98 0 top
R20118  10K  [0201]  147.27,72.59 0 top
R20119  10K  [0201]  147.27,73.2 0 top
R20120  10K  [0201]  147.27,73.81 0 top
R20121  10K  [0201]  147.27,74.42 0 top
R20122  10K  [0201]  147.27,75.03 0 top
R20123  10K  [0201]  147.27,75.64 0 top
R20124  10K  [0201]  147.27,76.25 0 top
R20125  10K  [0201]  147.27,76.86 0 top
R20126  10K  [0201]  147.27,77.47 0 top
R20127  10K  [0201]  147.27,78.08 0 top
R20128  10K  [0201]  147.27,78.69 0 top
R20129  10K  [0201]  147.27,79.3 0 top
R20130  10K  [0201]  147.27,79.91 0 top
R20131  10K  [0201]  147.27,80.52 0 top
R20132  10K  [0201]  147.27,81.13 0 top
R20133  10K  [0201]  147.27,81.74 0 top
R20134  10K  [0201]  147.27,82.35 0 top
R20135  10K  [0201]  147.27,82.96 0 top
R20136  10K  [0201]  147.27,83.57 0 top
R20137  10K  [0201]  147.27,84.18 0 top
R20138  10K  [0201]  147.27,84.79 0 top
R20139  10K  [0201]  147.27,85.39 0 top
R20140  10K  [0201]  147.27,86 0 top
R20141  10K  [0201]  147.27,86.61 0 top
R20142  10K  [0201]  147.27,87.22 0 top
R20143  10K  [0201]  147.27,87.83 0 top
R20144  10K  [0201]  147.27,88.44 0 top
R20145  10K  [0201]  147.27,89.05 0 top
R20146  10K  [0201]  147.27,89.66 0 top
R20147  10K  [0201]  147.27,90.27 0 top
R20148  10K  [0201]  147.27,90.88 0 top
R20149  10K  [0201]  147.27,91.49 0 top
R20150  10K  [0201]  147.27,92.1 0 top
R20151  10K  [0201]  147.27,92.71 0 top
R20152  10K  [0201]  147.27,93.32 0 top
R20153  10K  [0201]  147.27,93.93 0 top
R20154  10K  [0201]  147.27,94.54 0 top
R20155  10K  [0201]  147.27,95.15 0 top
R20156  10K  [0201]  147.27,95.76 0 top
R20157  10K  [0201]  147.27,96.37 0 top
R20158  10K  [0201]  147.27,96.98 0 top
R20159  10K  [0201]  147.27,97.59 0 top
R20160  10K  [0201]  147.27,98.2 0 top
R20161  10K  [0201]  147.27,98.81 0 top
R20162  10K  [0201]  147.27,99.42 0 top
R20163  10K  [0201]  147.27,100.03 0 top
R20164  10K  [0201]  147.27,100.63 0 top
R20165  10K  [0201]  147.27,101.24 0 top
R20166  10K  [0201]  147.27,101.85 0 top
R20167  10K  [0201]  147.27,102.46 0 top
R20168  10K  [0201]  147.27,103.07 0 top
R20169  10K  [0201]  147.27,103.68 0 top
R20170  10K  [0201]  147.27,104.29 0 top
R20171  10K  [0201]  147.27,104.9 0 top
R20172  10K  [0201]  147.27,105.51 0 top
R20173  10K  [0201]  147.27,106.12 0 top
R20174  10K  [0201]  147.27,106.73 0 top
R20175  10K  [0201]  147.27,107.34 0 top
R20176  10K  [0201]  147.27,107.95 0 top
R20177  10K  [0201]  147.27,108.56 0 top
R20178  10K  [0201]  147.27,109.17 0 top
R20179  10K  [0201]  147.27,109.78 0 top
R20180  10K  [0201]  147.27,110.39 0 top
R20181  10K  [0201]  147.27,111 0 top
R20182  10K  [0201]  147.27,111.61 0 top
R20183  10K  [0201]  147.27,112.22 0 top
R20184  10K  [0201]  147.27,112.83 0 top
R20185  10K  [0201]  147.27,113.44 0 top
R20186  10K  [0201]  147.27,114.05 0 top
R20187  10K  [0201]  147.27,114.66 0 top
R20188  10K  [0201]  147.27,115.27 0 top
R20189  10K  [0201]  147.27,115.87 0 top
R20190  10K  [0201]  147.27,116.48 0 top
R20191  10K  [0201]  147.27,117.09 0 top
R20192  10K  [0201]  147.27,117.7 0 top
R20193  10K  [0201]  147.27,118.31 0 top
R20194  10K  [0201]  147.27,118.92 0 top
R20195  10K  [0201]  147.27,119.53 0 top
R20196  10K  [0201]  147.27,120.14 0 top
R20197  10K  [0201]  147.27,120.75 0 top
R20198  10K  [0201]  147.27,121.36 0 top
R20199  10K  [0201]  147.27,121.97 0 top
R20200  10K  [0201]  147.27,122.58 0 top
R20201  10K  [0201]  148.49,1.27 0 top
R20202  10K  [0201]  148.49,1.88 0 top
R20203  10K  [0201]  148.49,2.49 0 top
R20204  10K  [0201]  148.49,3.1 0 top
R20205  10K  [0201]  148.49,3.71 0 top
R20206  10K  [0201]  148.49,4.32 0 top
R20207  10K  [0201]  148.49,4.93 0 top
R20208  10K  [0201]  148.49,5.54 0 top
R20209  10K  [0201]  148.49,6.15 0 top
R20210  10K  [0201]  148.49,6.76 0 top
R20211  10K  [0201]  148.49,7.37 0 top
R20212  10K  [0201]  148.49,7.98 0 top
R20213  10K  [0201]  148.49,8.59 0 top
R20214  10K  [0201]  148.49,9.19 0 top
R20215  10K  [0201]  148.49,9.8 0 top
R20216  10K  [0201]  148.49,10.41 0 top
R20217  10K  [0201]  148.49,11.02 0 top
R20218  10K  [0201]  148.49,11.63 0 top
R20219  10K  [0201]  148.49,12.24 0 top
R20220  10K  [0201]  148.49,12.85 0 top
R20221  10K  [0201]  148.49,13.46 0 top
R20222  10K  [0201]  148.49,14.07 0 top
R20223  10K  [0201]  148.49,14.68 0 top
R20224  10K  [0201]  148.49,15.29 0 top
R20225  10K  [0201]  148.49,15.9 0 top
R20226  10K  [0201]  148.49,16.51 0 top
R20227  10K  [0201]  148.49,17.12 0 top
R20228  10K  [0201]  148.49,17.73 0 top
R20229  10K  [0201]  148.49,18.34 0 top
R20230  10K  [0201]  148.49,18.95 0 top
R20231  10K  [0201]  148.49,19.56 0 top
R20232  10K  [0201]  148.49,20.17 0 top
R20233  10K  [0201]  148.49,20.78 0 top
R20234  10K  [0201]  148.49,21.39 0 top
R20235  10K  [0201]  148.49,22 0 top
R20236  10K  [0201]  148.49,22.61 0 top
R20237  10K  [0201]  148.49,23.22 0 top
R20238  10K  [0201]  148.49,23.83 0 top
R20239  10K  [0201]  148.49,24.43 0 top
R20240  10K  [0201]  148.49,25.04 0 top
R20241  10K  [0201]  148.49,25.65 0 top
R20242  10K  [0201]  148.49,26.26 0 top
R20243  10K  [0201]  148.49,26.87 0 top
R20244  10K  [0201]  148.49,27.48 0 top
R20245  10K  [0201]  148.49,28.09 0 top
R20246  10K  [0201]  148.49,28.7 0 top
R20247  10K  [0201]  148.49,29.31 0 top
R20248  10K  [0201]  148.49,29.92 0 top
R20249  10K  [0201]  148.49,30.53 0 top
R20250  10K  [0201]  148.49,31.14 0 top
R20251  10K  [0201]  148.49,31.75 0 top
R20252  10K  [0201]  148.49,32.36 0 top
R20253  10K  [0201]  148.49,32.97 0 top
R20254  10K  [0201]  148.49,33.58 0 top
R20255  10K  [0201]  148.49,34.19 0 top
R20256  10K  [0201]  148.49,34.8 0 top
R20257  10K  [0201]  148.49,35.41 0 top
R20258  10K  [0201]  148.49,36.02 0 top
R20259  10K  [0201]  148.49,36.63 0 top
R20260  10K  [0201]  148.49,37.24 0 top
R20261  10K  [0201]  148.49,37.85 0 top
R20262  10K  [0201]  148.49,38.46 0 top
R20263  10K  [0201]  148.49,39.07 0 top
R20264  10K  [0201]  148.49,39.67 0 top
R20265  10K  [0201]  148.49,40.28 0 top
R20266  10K  [0201]  148.49,40.89 0 top
R20267  10K  [0201]  148.49,41.5 0 top
R20268  10K  [0201]  148.49,42.11 0 top
R20269  10K  [0201]  148.49,42.72 0 top
R20270  10K  [0201]  148.49,43.33 0 top
R20271  10K  [0201]  148.49,43.94 0 top
R20272  10K  [0201]  148.49,44.55 0 top
R20273  10K  [0201]  148.49,45.16 0 top
R20274  10K  [0201]  148.49,45.77 0 top
R20275  10K  [0201]  148.49,46.38 0 top
R20276  10K  [0201]  148.49,46.99 0 top
R20277  10K  [0201]  148.49,47.6 0 top
R20278  10K  [0201]  148.49,48.21 0 top
R20279  10K  [0201]  148.49,48.82 0 top
R20280  10K  [0201]  148.49,49.43 0 top
R20281  10K  [0201]  148.49,50.04 0 top
R20282  10K  [0201]  148.49,50.65 0 top
R20283  10K  [0201]  148.49,51.26 0 top
R20284  10K  [0201]  148.49,51.87 0 top
R20285  10K  [0201]  148.49,52.48 0 top
R20286  10K  [0201]  148.49,53.09 0 top
R20287  10K  [0201]  148.49,53.7 0 top
R20288  10K  [0201]  148.49,54.31 0 top
R20289  10K  [0201]  148.49,54.91 0 top
R20290  10K  [0201]  148.49,55.52 0 top
R20291  10K  [0201]  148.49,56.13 0 top
R20292  10K  [0201]  148.49,56.74 0 top
R20293  10K  [0201]  148.49,57.35 0 top
R20294  10K  [0201]  148.49,57.96 0 top
R20295  10K  [0201]  148.49,58.57 0 top
R20296  10K  [0201]  148.49,59.18 0 top
R20297  10K  [0201]  148.49,59.79 0 top
R20298  10K  [0201]  148.49,60.4 0 top
R20299  10K  [0201]  148.49,61.01 0 top
R20300  10K  [0201]  148.49,61.62 0 top
R20301  10K  [0201]  148.49,62.23 0 top
R20302  10K  [0201]  148.49,62.84 0 top
R20303  10K  [0201]  148.49,63.45 0 top
R20304  10K  [0201]  148.49,64.06 0 top
R20305  10K  [0201]  148.49,64.67 0 top
R20306  10K  [0201]  148.49,65.28 0 top
R20307  10K  [0201]  148.49,65.89 0 top
R20308  10K  [0201]  148.49,66.5 0 top
R20309  10K  [0201]  148.49,67.11 0 top
R20310  10K  [0201]  148.49,67.72 0 top
R20311  10K  [0201]  148.49,68.33 0 top
R20312  10K  [0201]  148.49,68.94 0 top
R20313  10K  [0201]  148.49,69.55 0 top
R20314  10K  [0201]  148.49,70.15 0 top
R20315  10K  [0201]  148.49,70.76 0 top
R20316  10K  [0201]  148.49,71.37 0 top
R20317  10K  [0201]  148.49,71.98 0 top
R20318  10K  [0201]  148.49,72.59 0 top
R20319  10K  [0201]  148.49,73.2 0 top
R20320  10K  [0201]  148.49,73.81 0 top
R20321  10K  [0201]  148.49,74.42 0 top
R20322  10K  [0201]  148.49,75.03 0 top
R20323  10K  [0201]  148.49,75.64 0 top
R20324  10K  [0201]  148.49,76.25 0 top
R20325  10K  [0201]  148.49,76.86 0 top
R20326  10K  [0201]  148.49,77.47 0 top
R20327  10K  [0201]  148.49,78.08 0 top
R20328  10K  [0201]  148.49,78.69 0 top
R20329  10K  [0201]  148.49,79.3 0 top
R20330  10K  [0201]  148.49,79.91 0 top
R20331  10K  [0201]  148.49,80.52 0 top
R20332  10K  [0201]  148.49,81.13 0 top
R20333  10K  [0201]  148.49,81.74 0 top
R20334  10K  [0201]  148.49,82.35 0 top
R20335  10K  [0201]  148.49,82.96 0 top
R20336  10K  [0201]  148.49,83.57 0 top
R20337  10K  [0201]  148.49,84.18 0 top
R20338  10K  [0201]  148.49,84.79 0 top
R20339  10K  [0201]  148.49,85.39 0 top
R20340  10K  [0201]  148.49,86 0 top
R20341  10K  [0201]  148.49,86.61 0 top
R20342  10K  [0201]  148.49,87.22 0 top
R20343  10K  [0201]  148.49,87.83 0 top
R20344  10K  [0201]  148.49,88.44 0 top
R20345  10K  [0201]  148.49,89.05 0 top
R20346  10K  [0201]  148.49,89.66 0 top
R20347  10K  [0201]  148.49,90.27 0 top
R20348  10K  [0201]  148.49,90.88 0 top
R20349  10K  [0201]  148.49,91.49 0 top
R20350  10K  [0201]  148.49,92.1 0 top
R20351  10K  [0201]  148.49,92.71 0 top
R20352  10K  [0201]  148.49,93.32 0 top
R20353  10K  [0201]  148.49,93.93 0 top
R20354  10K  [0201]  148.49,94.54 0 top
R20355  10K  [0201]  148.49,95.15 0 top
R20356  10K  [0201]  148.49,95.76 0 top
R20357  10K  [0201]  148.49,96.37 0 top
R20358  10K  [0201]  148.49,96.98 0 top
R20359  10K  [0201]  148.49,97.59 0 top
R20360  10K  [0201]  148.49,98.2 0 top
R20361  10K  [0201]  148.49,98.81 0 top
R20362  10K  [0201]  148.49,99.42 0 top
R20363  10K  [0201]  148.49,100.03 0 top
R20364  10K  [0201]  148.49,100.63 0 top
R20365  10K  [0201]  148.49,101.24 0 top
R20366  10K  [0201]  148.49,101.85 0 top
R20367  10K  [0201]  148.49,102.46 0 top
R20368  10K  [0201]  148.49,103.07 0 top
R20369  10K  [0201]  148.49,103.68 0 top
R20370  10K  [0201]  148.49,104.29 0 top
R20371  10K  [0201]  148.49,104.9 0 top
R20372  10K  [0201]  148.49,105.51 0 top
R20373  10K  [0201]  148.49,106.12 0 top
R20374  10K  [0201]  148.49,106.73 0 top
R20375  10K  [0201]  148.49,107.34 0 top
R20376  10K  [0201]  148.49,107.95 0 top
R20377  10K  [0201]  148.49,108.56 0 top
R20378  10K  [0201]  148.49,109.17 0 top
R20379  10K  [0201]  148.49,109.78 0 top
R20380  10K  [0201]  148.49,110.39 0 top
R20381  10K  [0201]  148.49,111 0 top
R20382  10K  [0201]  148.49,111.61 0 top
R20383  10K  [0201]  148.49,112.22 0 top
R20384  10K  [0201]  148.49,112.83 0 top
R20385  10K  [0201]  148.49,113.44 0 top
R20386  10K  [0201]  148.49,114.05 0 top
R20387  10K  [0201]  148.49,114.66 0 top
R20388  10K  [0201]  148.49,115.27 0 top
R20389  10K  [0201]  148.49,115.87 0 top
R20390  10K  [0201]  148.49,116.48 0 top
R20391  10K  [0201]  148.49,117.09 0 top
R20392  10K  [0201]  148.49,117.7 0 top
R20393  10K  [0201]  148.49,118.31 0 top
R20394  10K  [0201]  148.49,118.92 0 top
R20395  10K  [0201]  148.49,119.53 0 top
R20396  10K  [0201]  148.49,120.14 0 top
R20397  10K  [0201]  148.49,120.75 0 top
R20398  10K  [0201]  148.49,121.36 0 top
R20399  10K  [0201]  148.49,121.97 0 top
R20400  10K  [0201]  148.49,122.58 0 top
R20401  10K  [0201]  149.71,1.27 0 top
R20402  10K  [0201]  149.71,1.88 0 top
R20403  10K  [0201]  149.71,2.49 0 top
R20404  10K  [0201]  149.71,3.1 0 top
R20405  10K  [0201]  149.71,3.71 0 top
R20406  10K  [0201]  149.71,4.32 0 top
R20407  10K  [0201]  149.71,4.93 0 top
R20408  10K  [0201]  149.71,5.54 0 top
R20409  10K  [0201]  149.71,6.15 0 top
R20410  10K  [0201]  149.71,6.76 0 top
R20411  10K  [0201]  149.71,7.37 0 top
R20412  10K  [0201]  149.71,7.98 0 top
R20413  10K  [0201]  149.71,8.59 0 top
R20414  10K  [0201]  149.71,9.19 0 top
R20415  10K  [0201]  149.71,9.8 0 top
R20416  10K  [0201]  149.71,10.41 0 top
R20417  10K  [0201]  149.71,11.02 0 top
R20418  10K  [0201]  149.71,11.63 0 top
R20419  10K  [0201]  149.71,12.24 0 top
R20420  10K  [0201]  149.71,12.85 0 top
R20421  10K  [0201]  149.71,13.46 0 top
R20422  10K  [0201]  149.71,14.07 0 top
R20423  10K  [0201]  149.71,14.68 0 top
R20424  10K  [0201]  149.71,15.29 0 top
R20425  10K  [0201]  149.71,15.9 0 top
R20426  10K  [0201]  149.71,16.51 0 top
R20427  10K  [0201]  149.71,17.12 0 top
R20428  10K  [0201]  149.71,17.73 0 top
R20429  10K  [0201]  149.71,18.34 0 top
R20430  10K  [0201]  149.71,18.95 0 top
R20431  10K  [0201]  149.71,19.56 0 top
R20432  10K  [0201]  149.71,20.17 0 top
R20433  10K  [0201]  149.71,20.78 0 top
R20434  10K  [0201]  149.71,21.39 0 top
R20435  10K  [0201]  149.71,22 0 top
R20436  10K  [0201]  149.71,22.61 0 top
R20437  10K  [0201]  149.71,23.22 0 top
R20438  10K  [0201]  149.71,23.83 0 top
R20439  10K  [0201]  149.71,24.43 0 top
R20440  10K  [0201]  149.71,25.04 0 top
R20441  10K  [0201]  149.71,25.65 0 top
R20442  10K  [0201]  149.71,26.26 0 top
R20443  10K  [0201]  149.71,26.87 0 top
R20444  10K  [0201]  149.71,27.48 0 top
R20445  10K  [0201]  149.71,28.09 0 top
R20446  10K  [0201]  149.71,28.7 0 top
R20447  10K  [0201]  149.71,29.31 0 top
R20448  10K  [0201]  149.71,29.92 0 top
R20449  10K  [0201]  149.71,30.53 0 top
R20450  10K  [0201]  149.71,31.14 0 top
R20451  10K  [0201]  149.71,31.75 0 top
R20452  10K  [0201]  149.71,32.36 0 top
R20453  10K  [0201]  149.71,32.97 0 top
R20454  10K  [0201]  149.71,33.58 0 top
R20455  10K  [0201]  149.71,34.19 0 top
R20456  10K  [0201]  149.71,34.8 0 top
R20457  10K  [0201]  149.71,35.41 0 top
R20458  10K  [0201]  149.71,36.02 0 top
R20459  10K  [0201]  149.71,36.63 0 top
R20460  10K  [0201]  149.71,37.24 0 top
R20461  10K  [0201]  149.71,37.85 0 top
R20462  10K  [0201]  149.71,38.46 0 top
R20463  10K  [0201]  149.71,39.07 0 top
R20464  10K  [0201]  149.71,39.67 0 top
R20465  10K  [0201]  149.71,40.28 0 top
R20466  10K  [0201]  149.71,40.89 0 top
R20467  10K  [0201]  149.71,41.5 0 top
R20468  10K  [0201]  149.71,42.11 0 top
R20469  10K  [0201]  149.71,42.72 0 top
R20470  10K  [0201]  149.71,43.33 0 top
R20471  10K  [0201]  149.71,43.94 0 top
R20472  10K  [0201]  149.71,44.55 0 top
R20473  10K  [0201]  149.71,45.16 0 top
R20474  10K  [0201]  149.71,45.77 0 top
R20475  10K  [0201]  149.71,46.38 0 top
R20476  10K  [0201]  149.71,46.99 0 top
R20477  10K  [0201]  149.71,47.6 0 top
R20478  10K  [0201]  149.71,48.21 0 top
R20479  10K  [0201]  149.71,48.82 0 top
R20480  10K  [0201]  149.71,49.43 0 top
R20481  10K  [0201]  149.71,50.04 0 top
R20482  10K  [0201]  149.71,50.65 0 top